# EasyEDA Pro project Q's HelloWorld KeyBoard.eprj, schematic SCH 主体扩展接口板V2
Create Date: 2022-10-16; Page Name: P1; Project Name: Q's HelloWorld KeyBoard; Schematic Name: SCH 主体扩展接口板V2; Update Date: 2022-10-16; Company: 嘉立创EDA; Page Size: A5; Version: V1.0
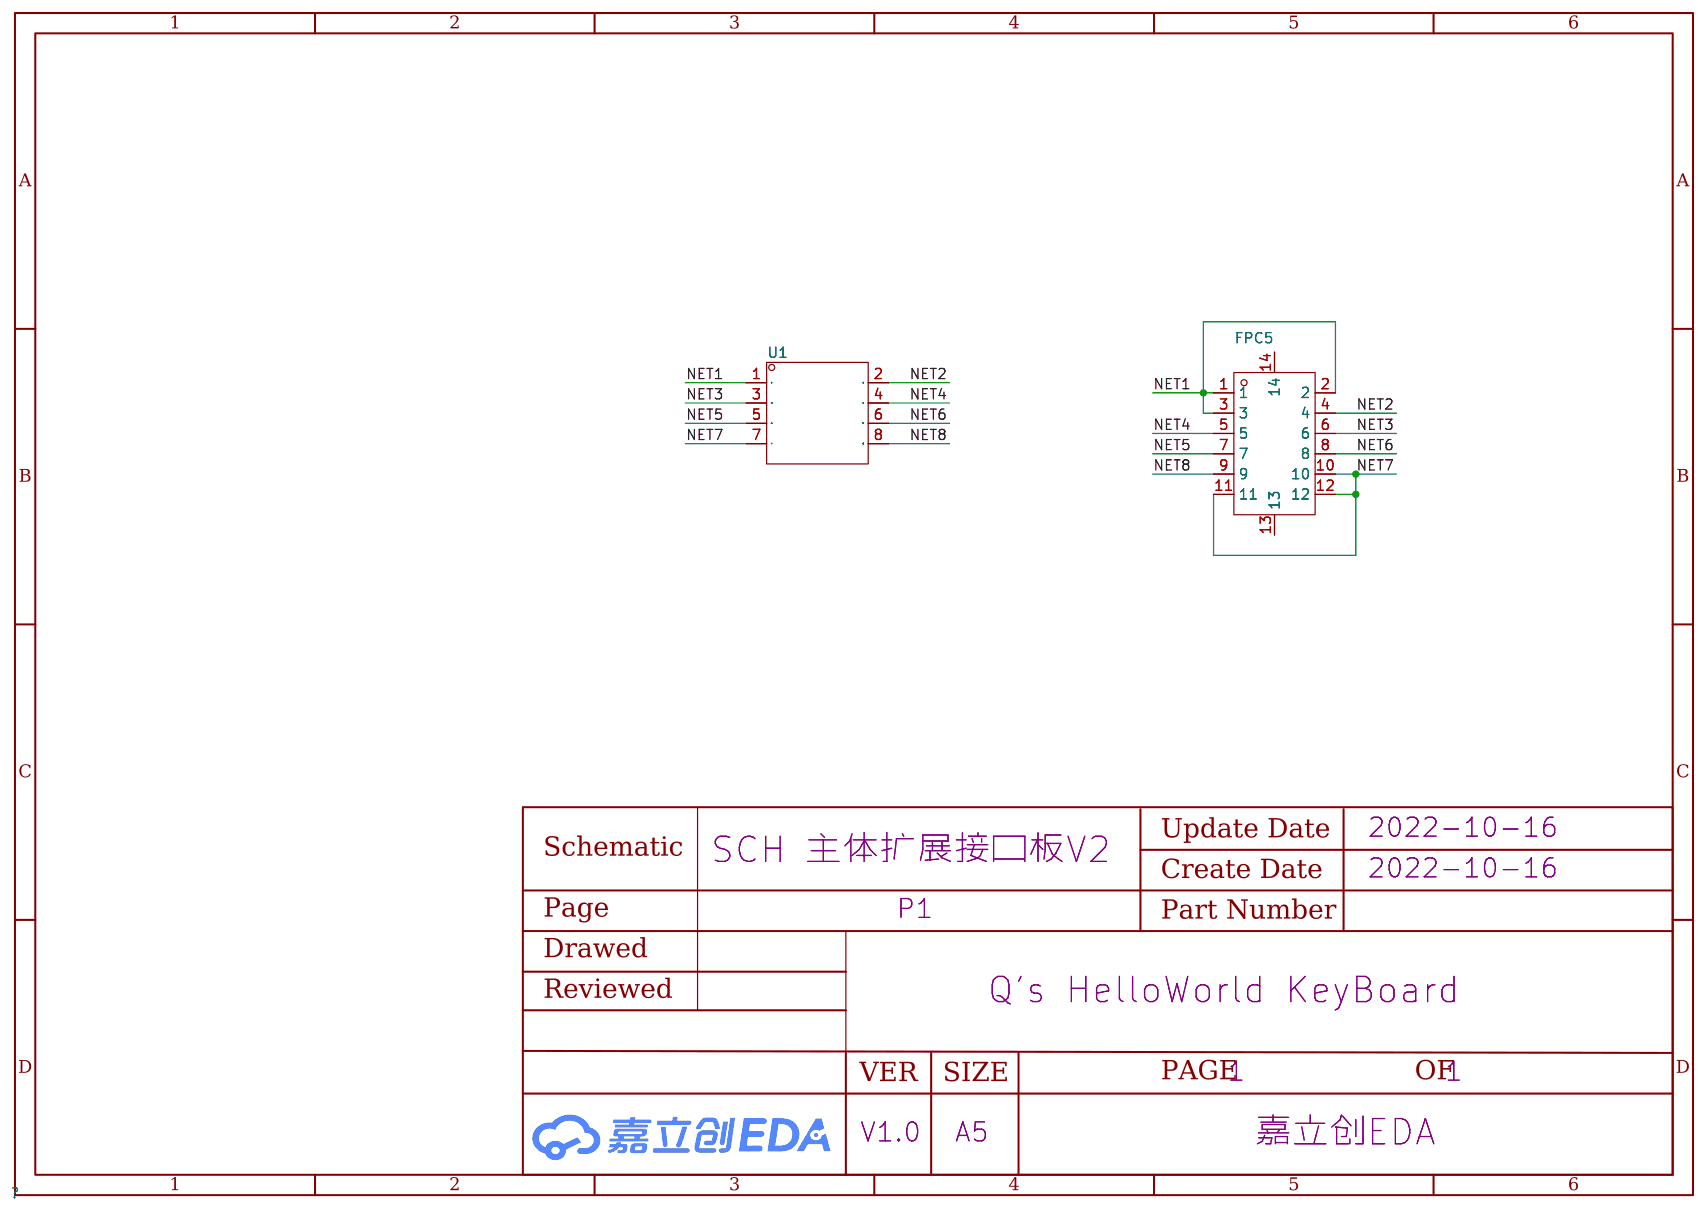
[diagram p4: schematic sheet]

## Parts
FPC5  0.5K-A-12PB  [FPC-SMD_12P-P0.50_HDGC_0.5K-A-12PB]
U1  MTP125-1204S1  [HDR-TH_8P-P2.54-V-M-R2-C4-S2.54]

## Library data of the parts
FPC5 = 0.5K-A-12PB: 间距:0.5mm;触点数量:12;锁定特性:抽屉式;安装类型:立贴;触点类型:单侧触点/垂直;工作温度范围:-20~+85;; LCSC Part Name: 0.5mm P数:12 抽屉式 单侧触点/垂直; Supplier Part: C2914138; Manufacturer: HDGC(华德共创); Supplier Footprint: SMD,P=0.5mm(交错脚); JLCPCB Part Class: Extended Part; Datasheet: https://atta.szlcsc.com/upload/public/pdf/source/20211102/71758412C03A9ABF15EB67930AA15715.pdf; Supplier: LCSC; Pitch: 0.5mm; Number of Contacts: 12; Locking Feature: 抽屉式; Mounting Type: 立贴; Contact Type: 单侧触点/垂直; Height Above Board: 4.5mm; FFC, FCB Thickness: 0.3mm; Operating Temperature Range: -20~+85
U1 = MTP125-1204S1: 间距:2.54mm;总PIN位数:8;排数:2;插针结构:2x4P;行距:2.54mm;安装类型:直插;圆针/方针:方针;额定电流:-;额定电压:-;配合针长度:6mm;塑高:2.5mm;端接针长度:3mm;触头材质:黄铜;触头镀层:-;工作温度范围:-40~+105;颜色:黑色;; LCSC Part Name: 2.54mm 2x4P 直插 方针; Supplier Part: C358693; Manufacturer: MINTRON(明硕); Supplier Footprint: 直插,P=2.54mm; JLCPCB Part Class: Extended Part; Datasheet: https://atta.szlcsc.com/upload/public/pdf/source/20190124/C358693_BDA2727DDB90EFE2D417117FFE47FBE2.pdf; Supplier: LCSC; Pitch: 2.54mm; Number of Pins: 8; Number of Rows: 2; Pin Structure: 2x4P; Row Spacing: 2.54mm; Mounting Type: 直插; Circluar Pins/Square Pins: 方针; Length of Mating Pin: 6mm; Insulation Height: 2.5mm; Length of End Connection Pin: 3mm; Contact Material: 黄铜; Operating Temperature Range: -40~+105; Color: 黑色

## Nets
NET1: FPC5.1 FPC5.2 FPC5.3 U1.1
NET2: FPC5.4 U1.2
NET3: FPC5.6 U1.3
NET4: FPC5.5 U1.4
NET5: FPC5.7 U1.5
NET6: FPC5.8 U1.6
NET7: FPC5.10 FPC5.11 FPC5.12 U1.7
NET8: FPC5.9 U1.8

Not connected (* = marked no-connect by the designer): FPC5 13 14
